# Altium schematic sheet FPGA_IOs.SchDoc
size A1
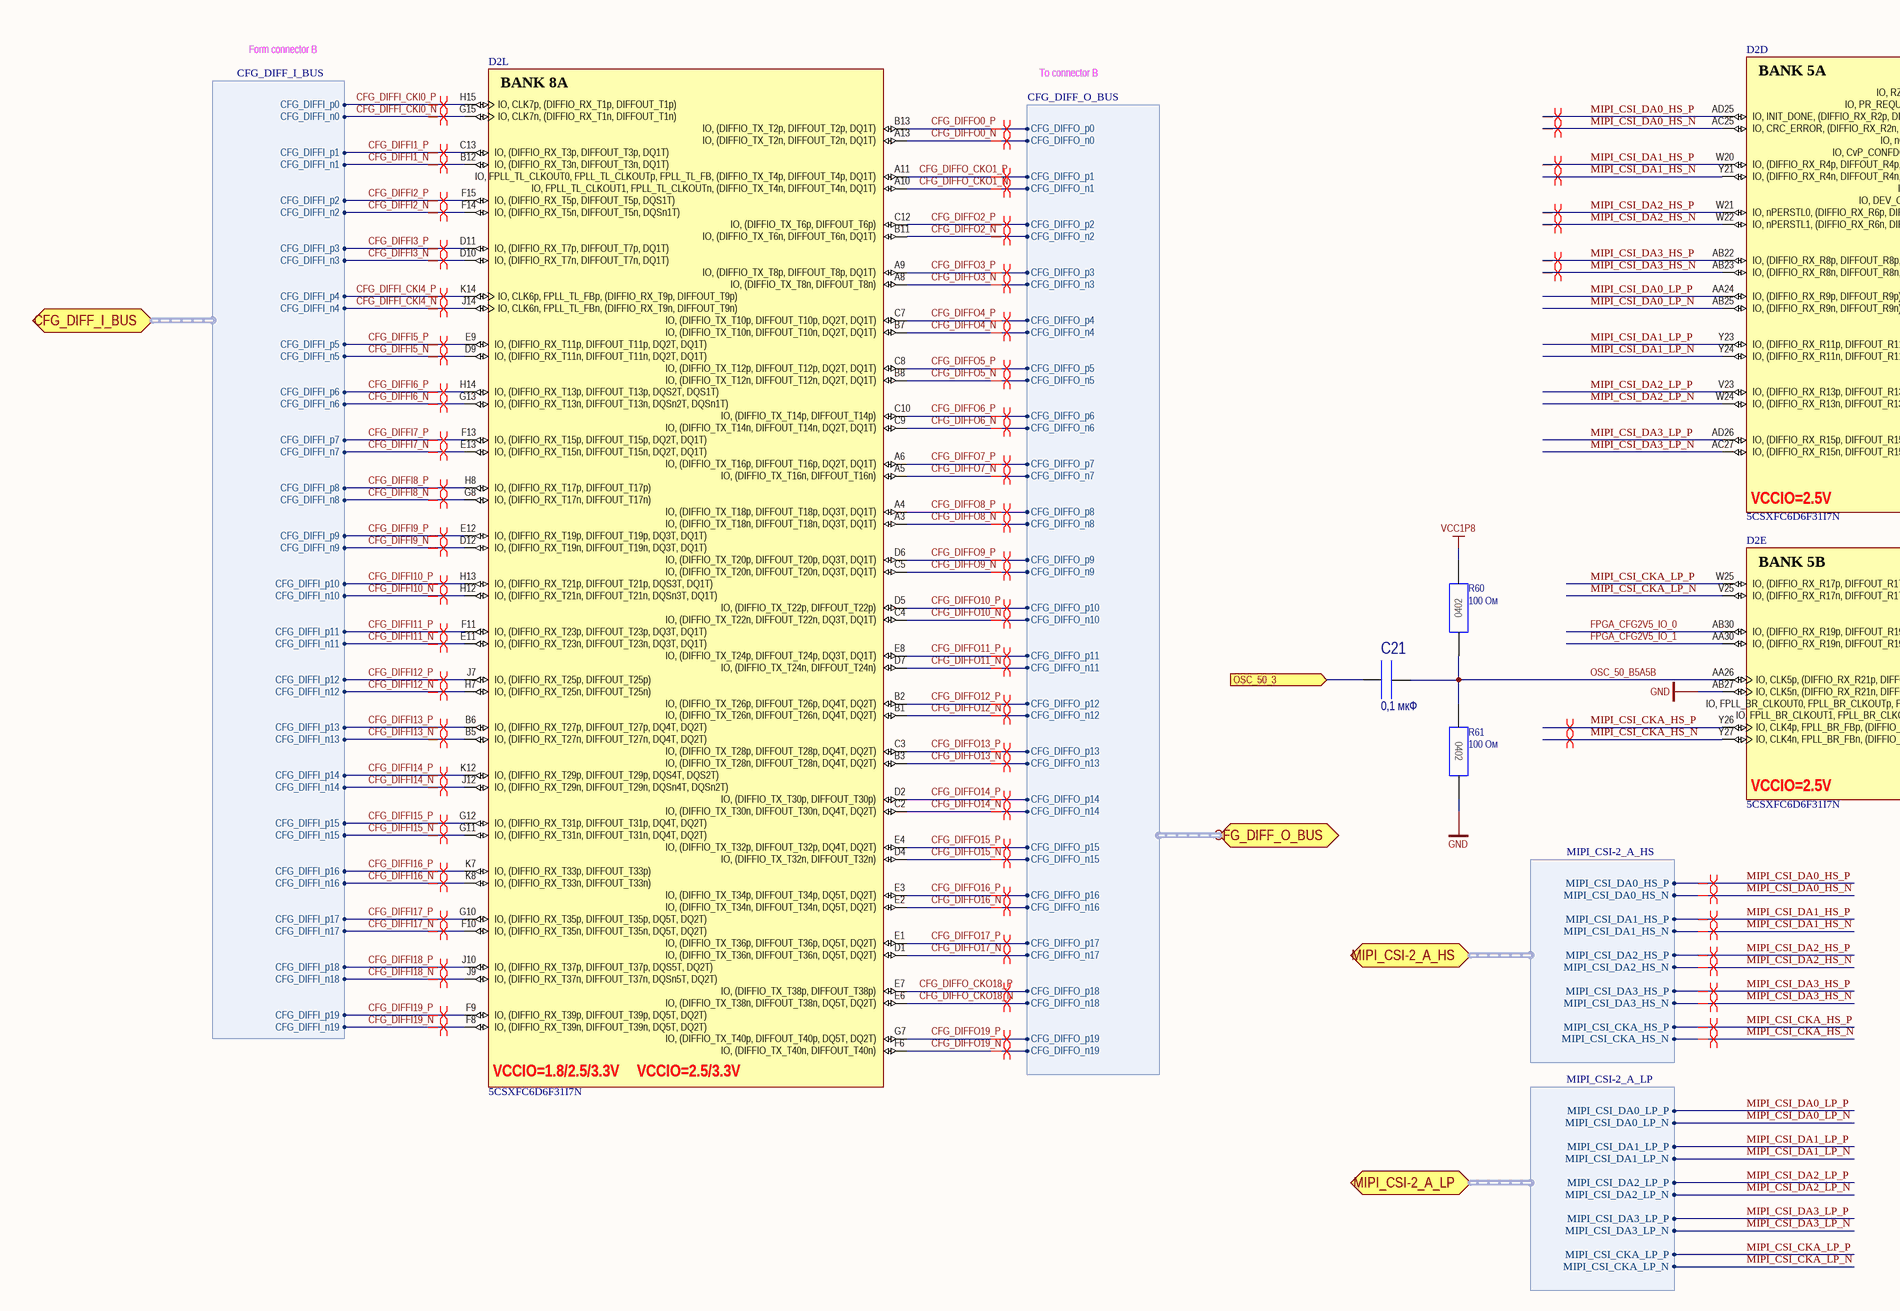
[diagram p0: FPGA_IOs.SchDoc, top left]
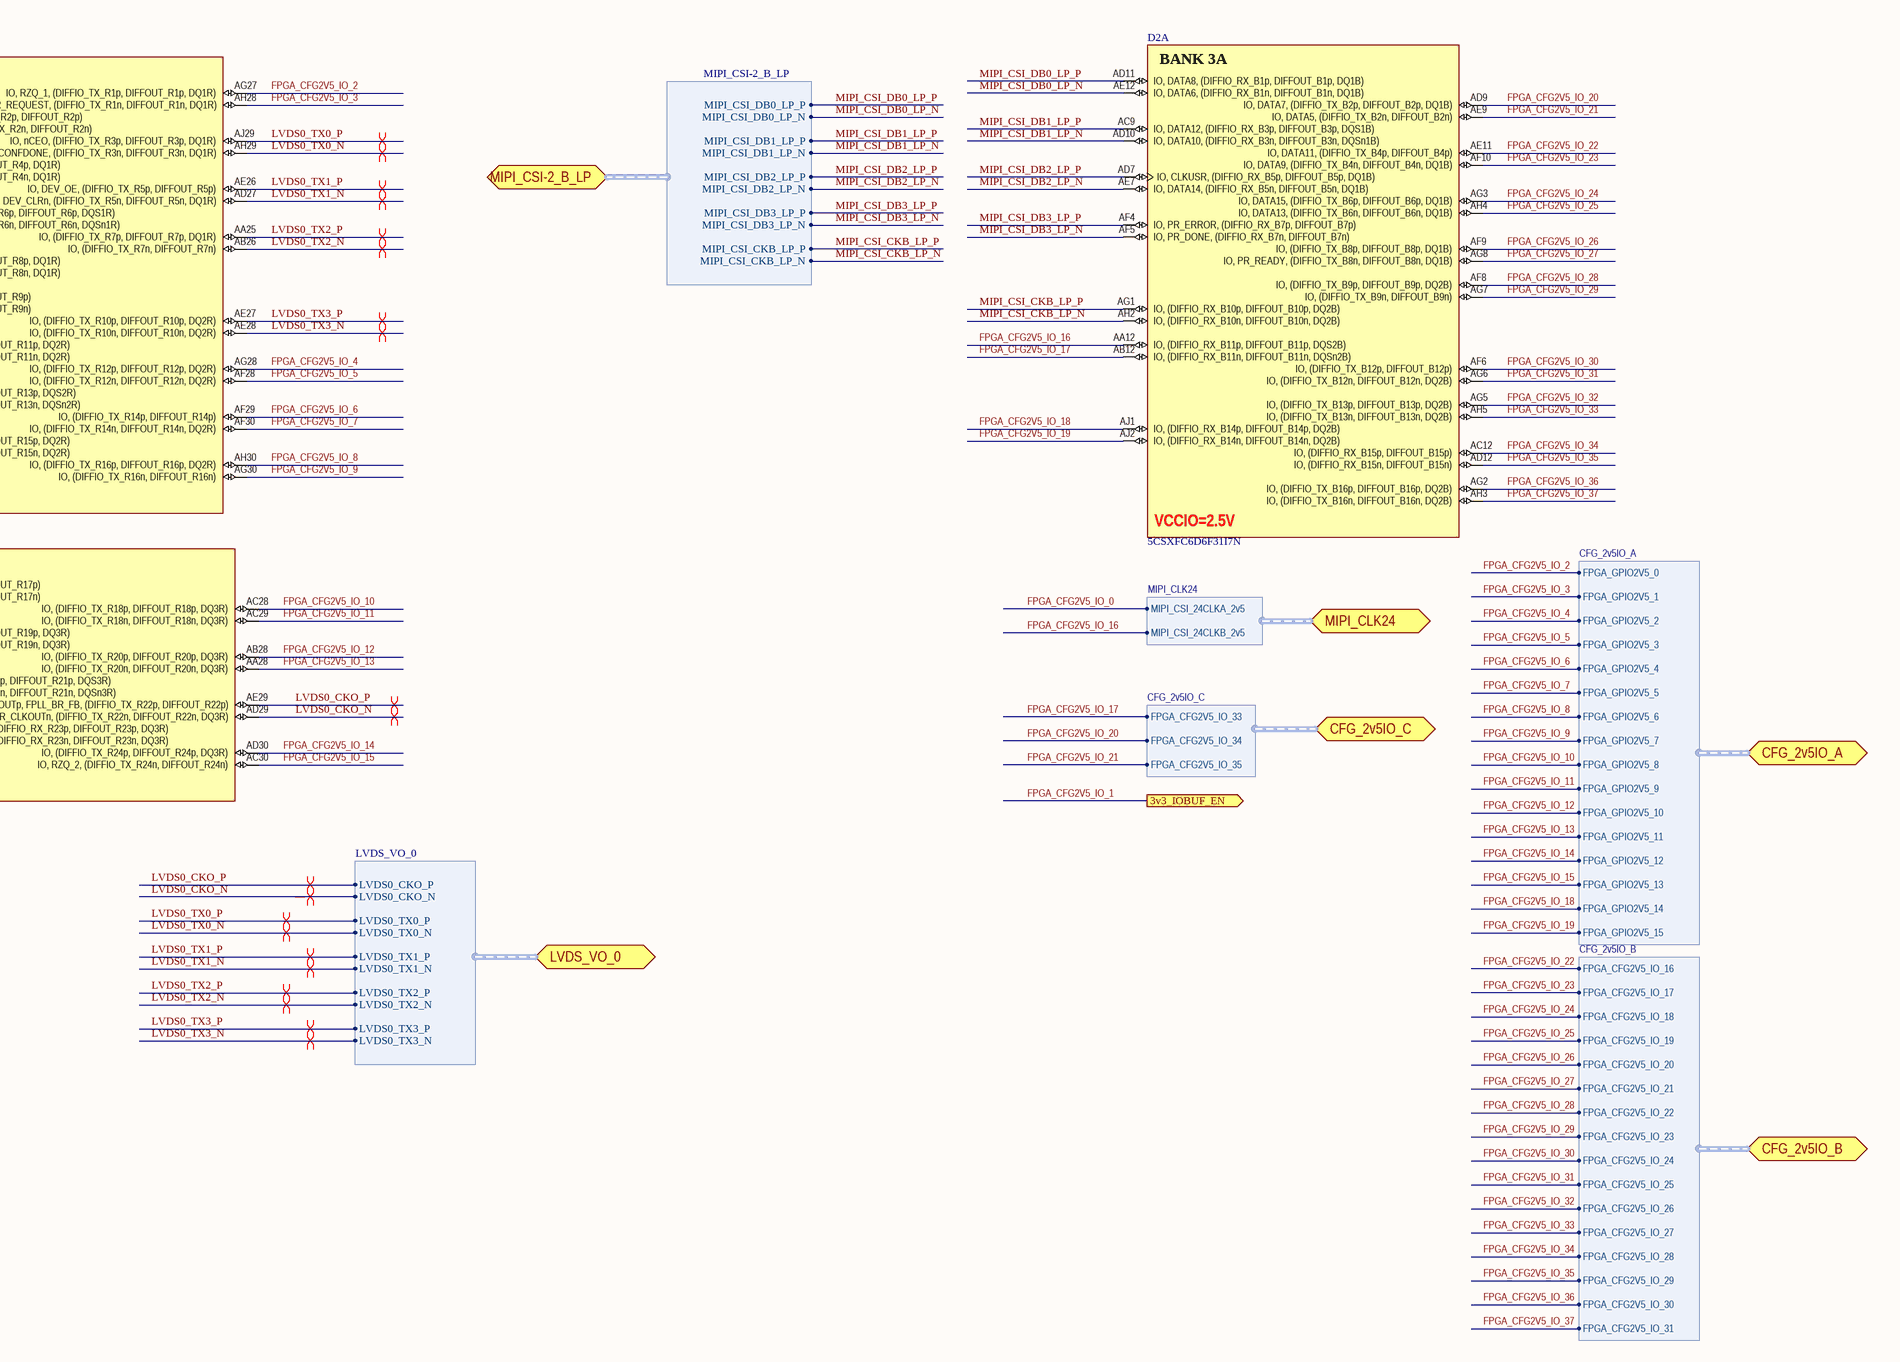
[diagram p1: FPGA_IOs.SchDoc, top right]
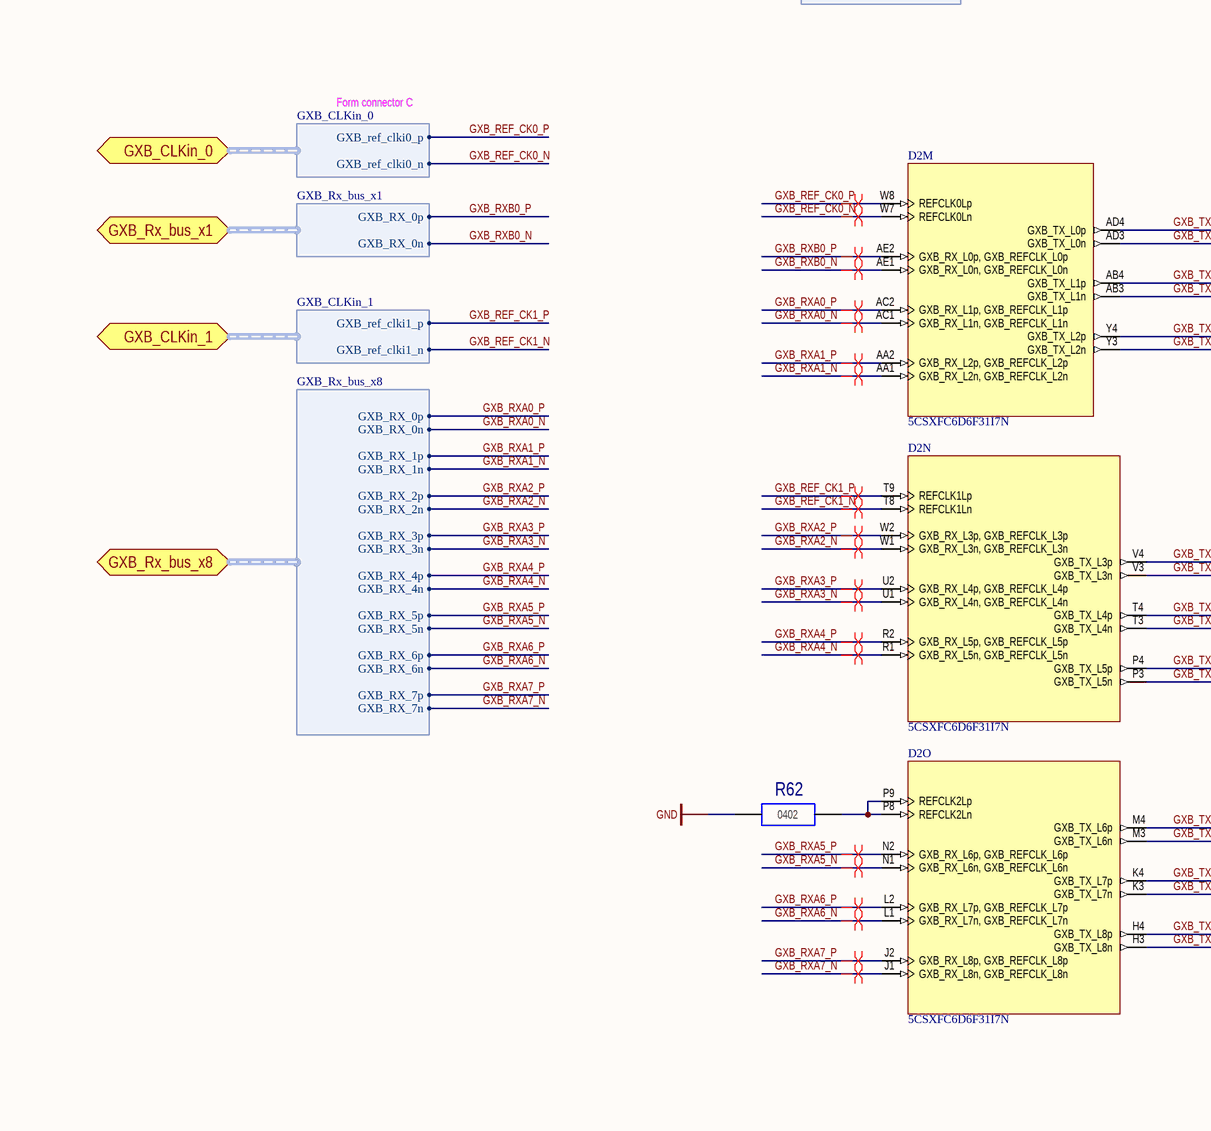
[diagram p2: FPGA_IOs.SchDoc, bottom left]
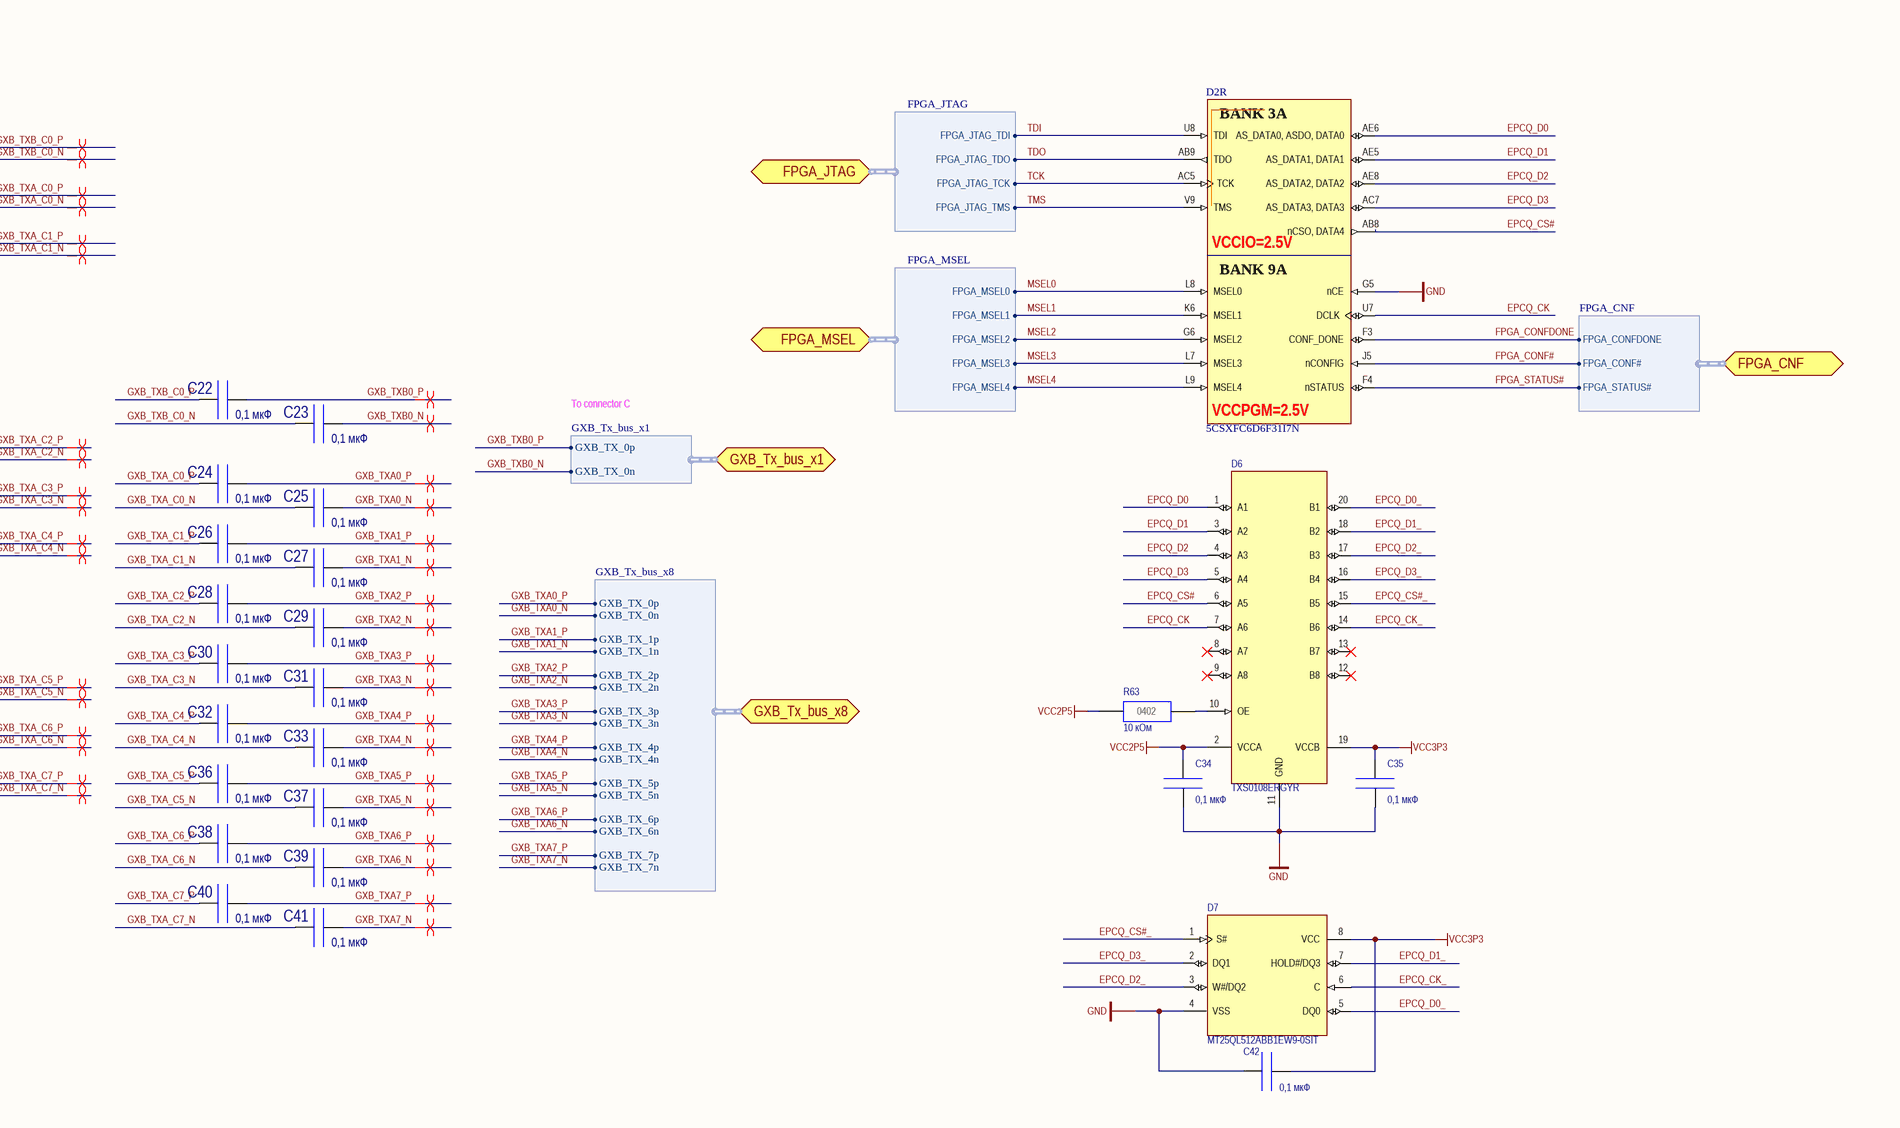
[diagram p3: FPGA_IOs.SchDoc, bottom right]

## Parts
C21  value 0,1 мкФ  [CC0402(1005)]  (hidden comment: CC0402-X7R-0,1 мкФ-20%-10В)
C22  value 0,1 мкФ  [CC0402(1005)]  (hidden comment: CC0402-X7R-0,1 мкФ-20%-10В)
C23  value 0,1 мкФ  [CC0402(1005)]  (hidden comment: CC0402-X7R-0,1 мкФ-20%-10В)
C24  value 0,1 мкФ  [CC0402(1005)]  (hidden comment: CC0402-X7R-0,1 мкФ-20%-10В)
C25  value 0,1 мкФ  [CC0402(1005)]  (hidden comment: CC0402-X7R-0,1 мкФ-20%-10В)
C26  value 0,1 мкФ  [CC0402(1005)]  (hidden comment: CC0402-X7R-0,1 мкФ-20%-10В)
C27  value 0,1 мкФ  [CC0402(1005)]  (hidden comment: CC0402-X7R-0,1 мкФ-20%-10В)
C28  value 0,1 мкФ  [CC0402(1005)]  (hidden comment: CC0402-X7R-0,1 мкФ-20%-10В)
C29  value 0,1 мкФ  [CC0402(1005)]  (hidden comment: CC0402-X7R-0,1 мкФ-20%-10В)
C30  value 0,1 мкФ  [CC0402(1005)]  (hidden comment: CC0402-X7R-0,1 мкФ-20%-10В)
C31  value 0,1 мкФ  [CC0402(1005)]  (hidden comment: CC0402-X7R-0,1 мкФ-20%-10В)
C32  value 0,1 мкФ  [CC0402(1005)]  (hidden comment: CC0402-X7R-0,1 мкФ-20%-10В)
C33  value 0,1 мкФ  [CC0402(1005)]  (hidden comment: CC0402-X7R-0,1 мкФ-20%-10В)
C34  value 0,1 мкФ  [CC0402(1005)]  (hidden comment: CC0402-X7R-0,1 мкФ-20%-10В)
C35  value 0,1 мкФ  [CC0402(1005)]  (hidden comment: CC0402-X7R-0,1 мкФ-20%-10В)
C36  value 0,1 мкФ  [CC0402(1005)]  (hidden comment: CC0402-X7R-0,1 мкФ-20%-10В)
C37  value 0,1 мкФ  [CC0402(1005)]  (hidden comment: CC0402-X7R-0,1 мкФ-20%-10В)
C38  value 0,1 мкФ  [CC0402(1005)]  (hidden comment: CC0402-X7R-0,1 мкФ-20%-10В)
C39  value 0,1 мкФ  [CC0402(1005)]  (hidden comment: CC0402-X7R-0,1 мкФ-20%-10В)
C40  value 0,1 мкФ  [CC0402(1005)]  (hidden comment: CC0402-X7R-0,1 мкФ-20%-10В)
C41  value 0,1 мкФ  [CC0402(1005)]  (hidden comment: CC0402-X7R-0,1 мкФ-20%-10В)
C42  value 0,1 мкФ  [CC0402(1005)]  (hidden comment: CC0402-X7R-0,1 мкФ-20%-10В)
D2  5CSXFC6D6F31I7N  [ALTR-FBGA896_A-200]  (parts A,D,E,L,M,N,O,R of 24)
D6  TXS0108ERGYR  [QFN50P450X350X100_HS-21N]
D7  MT25QL512ABB1EW9-0SIT  [SON127P800X80_HS-9N]
R60  value 100 Ом  [CR0402(1005)]  (hidden comment: CR0402-100 Ом-±5%)
R61  value 100 Ом  [CR0402(1005)]  (hidden comment: CR0402-100 Ом-±5%)
R62  CR0402-0 Ом-±5%  [CR0402(1005)]  (value not drawn)
R63  value 10 кОм  [CR0402(1005)]  (hidden comment: CR0402-10 кОм-±5%)

## Ports
3v3_IOBUF_EN (out), CFG_2v5IO_A (harness CFG_2v5IO_A), CFG_2v5IO_B (harness CFG_2v5IO_B), CFG_2v5IO_C (harness CFG_2v5IO_C), CFG_DIFF_I_BUS (harness CFG_DIFF_I_BUS), CFG_DIFF_O_BUS (harness CFG_DIFF_O_BUS), FPGA_CNF (harness FPGA_CNF), FPGA_JTAG (harness FPGA_JTAG), FPGA_MSEL (harness FPGA_MSEL), GXB_CLKin_0 (harness GXB_CLKin_0), GXB_CLKin_1 (harness GXB_CLKin_1), GXB_Rx_bus_x1 (harness GXB_Rx_bus_x1), GXB_Rx_bus_x8 (harness GXB_Rx_bus_x8), GXB_Tx_bus_x1 (harness GXB_Tx_bus_x1), GXB_Tx_bus_x8 (harness GXB_Tx_bus_x8), LVDS_VO_0 (harness LVDS_VO_0), MIPI_CLK24 (harness MIPI_CLK24), MIPI_CSI-2_A_HS (harness MIPI_CSI-2_A_HS), MIPI_CSI-2_A_LP (harness MIPI_CSI-2_A_LP), MIPI_CSI-2_B_LP (harness MIPI_CSI-2_B_LP), OSC_50_3 (in)

## Harnesses
GXB_Rx_bus_x8: GXB_RX_0p, GXB_RX_0n, GXB_RX_1p, GXB_RX_1n, GXB_RX_2p, GXB_RX_2n, GXB_RX_3p, GXB_RX_3n, GXB_RX_4p, GXB_RX_4n, GXB_RX_5p, GXB_RX_5n, GXB_RX_6p, GXB_RX_6n, GXB_RX_7p, GXB_RX_7n
GXB_Tx_bus_x8: GXB_TX_0p, GXB_TX_0n, GXB_TX_1p, GXB_TX_1n, GXB_TX_2p, GXB_TX_2n, GXB_TX_3p, GXB_TX_3n, GXB_TX_4p, GXB_TX_4n, GXB_TX_5p, GXB_TX_5n, GXB_TX_6p, GXB_TX_6n, GXB_TX_7p, GXB_TX_7n
GXB_CLKin_0: GXB_ref_clki0_p, GXB_ref_clki0_n
GXB_Rx_bus_x1: GXB_RX_0p, GXB_RX_0n
GXB_Tx_bus_x1: GXB_TX_0p, GXB_TX_0n
GXB_CLKin_1: GXB_ref_clki1_p, GXB_ref_clki1_n
LVDS_VO_0: LVDS0_CKO_P, LVDS0_CKO_N, LVDS0_TX0_P, LVDS0_TX0_N, LVDS0_TX1_P, LVDS0_TX1_N, LVDS0_TX2_P, LVDS0_TX2_N, LVDS0_TX3_P, LVDS0_TX3_N
MIPI_CSI-2_A_HS: MIPI_CSI_DA0_HS_N, MIPI_CSI_DA0_HS_P, MIPI_CSI_DA1_HS_N, MIPI_CSI_DA1_HS_P, MIPI_CSI_DA2_HS_P, MIPI_CSI_DA2_HS_N, MIPI_CSI_DA3_HS_N, MIPI_CSI_DA3_HS_P, MIPI_CSI_CKA_HS_N, MIPI_CSI_CKA_HS_P
CFG_DIFF_I_BUS: CFG_DIFFI_p0, CFG_DIFFI_p1, CFG_DIFFI_p2, CFG_DIFFI_p3, CFG_DIFFI_p4, CFG_DIFFI_p5, CFG_DIFFI_p6, CFG_DIFFI_p7, CFG_DIFFI_p8, CFG_DIFFI_p9, CFG_DIFFI_p10, CFG_DIFFI_p11, CFG_DIFFI_p12, CFG_DIFFI_p13, CFG_DIFFI_p14, CFG_DIFFI_p15, CFG_DIFFI_p16, CFG_DIFFI_p17, CFG_DIFFI_p18, CFG_DIFFI_p19, CFG_DIFFI_n0, CFG_DIFFI_n1, CFG_DIFFI_n2, CFG_DIFFI_n3, CFG_DIFFI_n4, CFG_DIFFI_n5, CFG_DIFFI_n6, CFG_DIFFI_n7, CFG_DIFFI_n8, CFG_DIFFI_n9, CFG_DIFFI_n10, CFG_DIFFI_n11, CFG_DIFFI_n12, CFG_DIFFI_n13, CFG_DIFFI_n14, CFG_DIFFI_n15, CFG_DIFFI_n16, CFG_DIFFI_n17, CFG_DIFFI_n18, CFG_DIFFI_n19
CFG_DIFF_O_BUS: CFG_DIFFO_p0, CFG_DIFFO_n0, CFG_DIFFO_p1, CFG_DIFFO_p2, CFG_DIFFO_p3, CFG_DIFFO_p4, CFG_DIFFO_p5, CFG_DIFFO_p6, CFG_DIFFO_p7, CFG_DIFFO_p8, CFG_DIFFO_p9, CFG_DIFFO_p10, CFG_DIFFO_p11, CFG_DIFFO_p12, CFG_DIFFO_p13, CFG_DIFFO_p14, CFG_DIFFO_p15, CFG_DIFFO_p16, CFG_DIFFO_p17, CFG_DIFFO_p18, CFG_DIFFO_p19, CFG_DIFFO_n1, CFG_DIFFO_n2, CFG_DIFFO_n3, CFG_DIFFO_n4, CFG_DIFFO_n5, CFG_DIFFO_n6, CFG_DIFFO_n7, CFG_DIFFO_n8, CFG_DIFFO_n9, CFG_DIFFO_n10, CFG_DIFFO_n11, CFG_DIFFO_n12, CFG_DIFFO_n13, CFG_DIFFO_n14, CFG_DIFFO_n15, CFG_DIFFO_n16, CFG_DIFFO_n17, CFG_DIFFO_n18, CFG_DIFFO_n19
MIPI_CSI-2_B_LP: MIPI_CSI_DB0_LP_P, MIPI_CSI_DB0_LP_N, MIPI_CSI_DB1_LP_P, MIPI_CSI_DB1_LP_N, MIPI_CSI_DB2_LP_N, MIPI_CSI_DB2_LP_P, MIPI_CSI_DB3_LP_P, MIPI_CSI_DB3_LP_N, MIPI_CSI_CKB_LP_P, MIPI_CSI_CKB_LP_N
MIPI_CSI-2_A_LP: MIPI_CSI_DA0_LP_P, MIPI_CSI_DA0_LP_N, MIPI_CSI_DA1_LP_P, MIPI_CSI_DA1_LP_N, MIPI_CSI_DA2_LP_N, MIPI_CSI_DA2_LP_P, MIPI_CSI_DA3_LP_P, MIPI_CSI_DA3_LP_N, MIPI_CSI_CKA_LP_P, MIPI_CSI_CKA_LP_N
FPGA_JTAG: FPGA_JTAG_TDI, FPGA_JTAG_TDO, FPGA_JTAG_TCK, FPGA_JTAG_TMS
FPGA_MSEL: FPGA_MSEL0, FPGA_MSEL1, FPGA_MSEL2, FPGA_MSEL3, FPGA_MSEL4
CFG_2v5IO_A: FPGA_GPIO2V5_0, FPGA_GPIO2V5_1, FPGA_GPIO2V5_2, FPGA_GPIO2V5_3, FPGA_GPIO2V5_4, FPGA_GPIO2V5_5, FPGA_GPIO2V5_6, FPGA_GPIO2V5_7, FPGA_GPIO2V5_8, FPGA_GPIO2V5_9, FPGA_GPIO2V5_10, FPGA_GPIO2V5_11, FPGA_GPIO2V5_12, FPGA_GPIO2V5_13, FPGA_GPIO2V5_14, FPGA_GPIO2V5_15
CFG_2v5IO_B: FPGA_CFG2V5_IO_16, FPGA_CFG2V5_IO_17, FPGA_CFG2V5_IO_18, FPGA_CFG2V5_IO_19, FPGA_CFG2V5_IO_20, FPGA_CFG2V5_IO_21, FPGA_CFG2V5_IO_22, FPGA_CFG2V5_IO_23, FPGA_CFG2V5_IO_24, FPGA_CFG2V5_IO_25, FPGA_CFG2V5_IO_26, FPGA_CFG2V5_IO_27, FPGA_CFG2V5_IO_28, FPGA_CFG2V5_IO_29, FPGA_CFG2V5_IO_30, FPGA_CFG2V5_IO_31
MIPI_CLK24: MIPI_CSI_24CLKA_2v5, MIPI_CSI_24CLKB_2v5
CFG_2v5IO_C: FPGA_CFG2V5_IO_33, FPGA_CFG2V5_IO_34, FPGA_CFG2V5_IO_35
FPGA_CNF: FPGA_STATUS#, FPGA_CONF#, FPGA_CONFDONE

## Nets
GND: C34.1(+) C35.1(+) C42.1(+) D2.AB27(IO,_CLK5n,_(DIFFIO_RX_R21n,_DIFFOUT_R21n,_DQSn3R)) D2.G5(nCE) D6.11(GND) D7.4(VSS) R61.2(-) R62.1(+)
VCC1P8: R60.2(-)
VCC2P5: C34.2(-) D6.2(VCCA) R63.1(+)
VCC3P3: C35.2(-) C42.2(-) D6.19(VCCB) D7.8(VCC)
CFG_DIFFI1_N: D2.B12(IO,_(DIFFIO_RX_T3n,_DIFFOUT_T3n,_DQ1T)) ; port CFG_DIFF_I_BUS.CFG_DIFFI_n1
CFG_DIFFI1_P: D2.C13(IO,_(DIFFIO_RX_T3p,_DIFFOUT_T3p,_DQ1T)) ; port CFG_DIFF_I_BUS.CFG_DIFFI_p1
CFG_DIFFI2_N: D2.F14(IO,_(DIFFIO_RX_T5n,_DIFFOUT_T5n,_DQSn1T)) ; port CFG_DIFF_I_BUS.CFG_DIFFI_n2
CFG_DIFFI2_P: D2.F15(IO,_(DIFFIO_RX_T5p,_DIFFOUT_T5p,_DQS1T)) ; port CFG_DIFF_I_BUS.CFG_DIFFI_p2
CFG_DIFFI3_N: D2.D10(IO,_(DIFFIO_RX_T7n,_DIFFOUT_T7n,_DQ1T)) ; port CFG_DIFF_I_BUS.CFG_DIFFI_n3
CFG_DIFFI3_P: D2.D11(IO,_(DIFFIO_RX_T7p,_DIFFOUT_T7p,_DQ1T)) ; port CFG_DIFF_I_BUS.CFG_DIFFI_p3
CFG_DIFFI5_N: D2.D9(IO,_(DIFFIO_RX_T11n,_DIFFOUT_T11n,_DQ2T,_DQ1T)) ; port CFG_DIFF_I_BUS.CFG_DIFFI_n5
CFG_DIFFI5_P: D2.E9(IO,_(DIFFIO_RX_T11p,_DIFFOUT_T11p,_DQ2T,_DQ1T)) ; port CFG_DIFF_I_BUS.CFG_DIFFI_p5
CFG_DIFFI6_N: D2.G13(IO,_(DIFFIO_RX_T13n,_DIFFOUT_T13n,_DQSn2T,_DQSn1T)) ; port CFG_DIFF_I_BUS.CFG_DIFFI_n6
CFG_DIFFI6_P: D2.H14(IO,_(DIFFIO_RX_T13p,_DIFFOUT_T13p,_DQS2T,_DQS1T)) ; port CFG_DIFF_I_BUS.CFG_DIFFI_p6
CFG_DIFFI7_N: D2.E13(IO,_(DIFFIO_RX_T15n,_DIFFOUT_T15n,_DQ2T,_DQ1T)) ; port CFG_DIFF_I_BUS.CFG_DIFFI_n7
CFG_DIFFI7_P: D2.F13(IO,_(DIFFIO_RX_T15p,_DIFFOUT_T15p,_DQ2T,_DQ1T)) ; port CFG_DIFF_I_BUS.CFG_DIFFI_p7
CFG_DIFFI8_N: D2.G8(IO,_(DIFFIO_RX_T17n,_DIFFOUT_T17n)) ; port CFG_DIFF_I_BUS.CFG_DIFFI_n8
CFG_DIFFI8_P: D2.H8(IO,_(DIFFIO_RX_T17p,_DIFFOUT_T17p)) ; port CFG_DIFF_I_BUS.CFG_DIFFI_p8
CFG_DIFFI9_N: D2.D12(IO,_(DIFFIO_RX_T19n,_DIFFOUT_T19n,_DQ3T,_DQ1T)) ; port CFG_DIFF_I_BUS.CFG_DIFFI_n9
CFG_DIFFI9_P: D2.E12(IO,_(DIFFIO_RX_T19p,_DIFFOUT_T19p,_DQ3T,_DQ1T)) ; port CFG_DIFF_I_BUS.CFG_DIFFI_p9
CFG_DIFFI10_N: D2.H12(IO,_(DIFFIO_RX_T21n,_DIFFOUT_T21n,_DQSn3T,_DQ1T)) ; port CFG_DIFF_I_BUS.CFG_DIFFI_n10
CFG_DIFFI10_P: D2.H13(IO,_(DIFFIO_RX_T21p,_DIFFOUT_T21p,_DQS3T,_DQ1T)) ; port CFG_DIFF_I_BUS.CFG_DIFFI_p10
CFG_DIFFI11_N: D2.E11(IO,_(DIFFIO_RX_T23n,_DIFFOUT_T23n,_DQ3T,_DQ1T)) ; port CFG_DIFF_I_BUS.CFG_DIFFI_n11
CFG_DIFFI11_P: D2.F11(IO,_(DIFFIO_RX_T23p,_DIFFOUT_T23p,_DQ3T,_DQ1T)) ; port CFG_DIFF_I_BUS.CFG_DIFFI_p11
CFG_DIFFI12_N: D2.H7(IO,_(DIFFIO_RX_T25n,_DIFFOUT_T25n)) ; port CFG_DIFF_I_BUS.CFG_DIFFI_n12
CFG_DIFFI12_P: D2.J7(IO,_(DIFFIO_RX_T25p,_DIFFOUT_T25p)) ; port CFG_DIFF_I_BUS.CFG_DIFFI_p12
CFG_DIFFI13_N: D2.B5(IO,_(DIFFIO_RX_T27n,_DIFFOUT_T27n,_DQ4T,_DQ2T)) ; port CFG_DIFF_I_BUS.CFG_DIFFI_n13
CFG_DIFFI13_P: D2.B6(IO,_(DIFFIO_RX_T27p,_DIFFOUT_T27p,_DQ4T,_DQ2T)) ; port CFG_DIFF_I_BUS.CFG_DIFFI_p13
CFG_DIFFI14_N: D2.J12(IO,_(DIFFIO_RX_T29n,_DIFFOUT_T29n,_DQSn4T,_DQSn2T)) ; port CFG_DIFF_I_BUS.CFG_DIFFI_n14
CFG_DIFFI14_P: D2.K12(IO,_(DIFFIO_RX_T29p,_DIFFOUT_T29p,_DQS4T,_DQS2T)) ; port CFG_DIFF_I_BUS.CFG_DIFFI_p14
CFG_DIFFI15_N: D2.G11(IO,_(DIFFIO_RX_T31n,_DIFFOUT_T31n,_DQ4T,_DQ2T)) ; port CFG_DIFF_I_BUS.CFG_DIFFI_n15